# EasyEDA Pro project STM32F103C8T6_CAN.eprj (continued)
## Nets (continued)
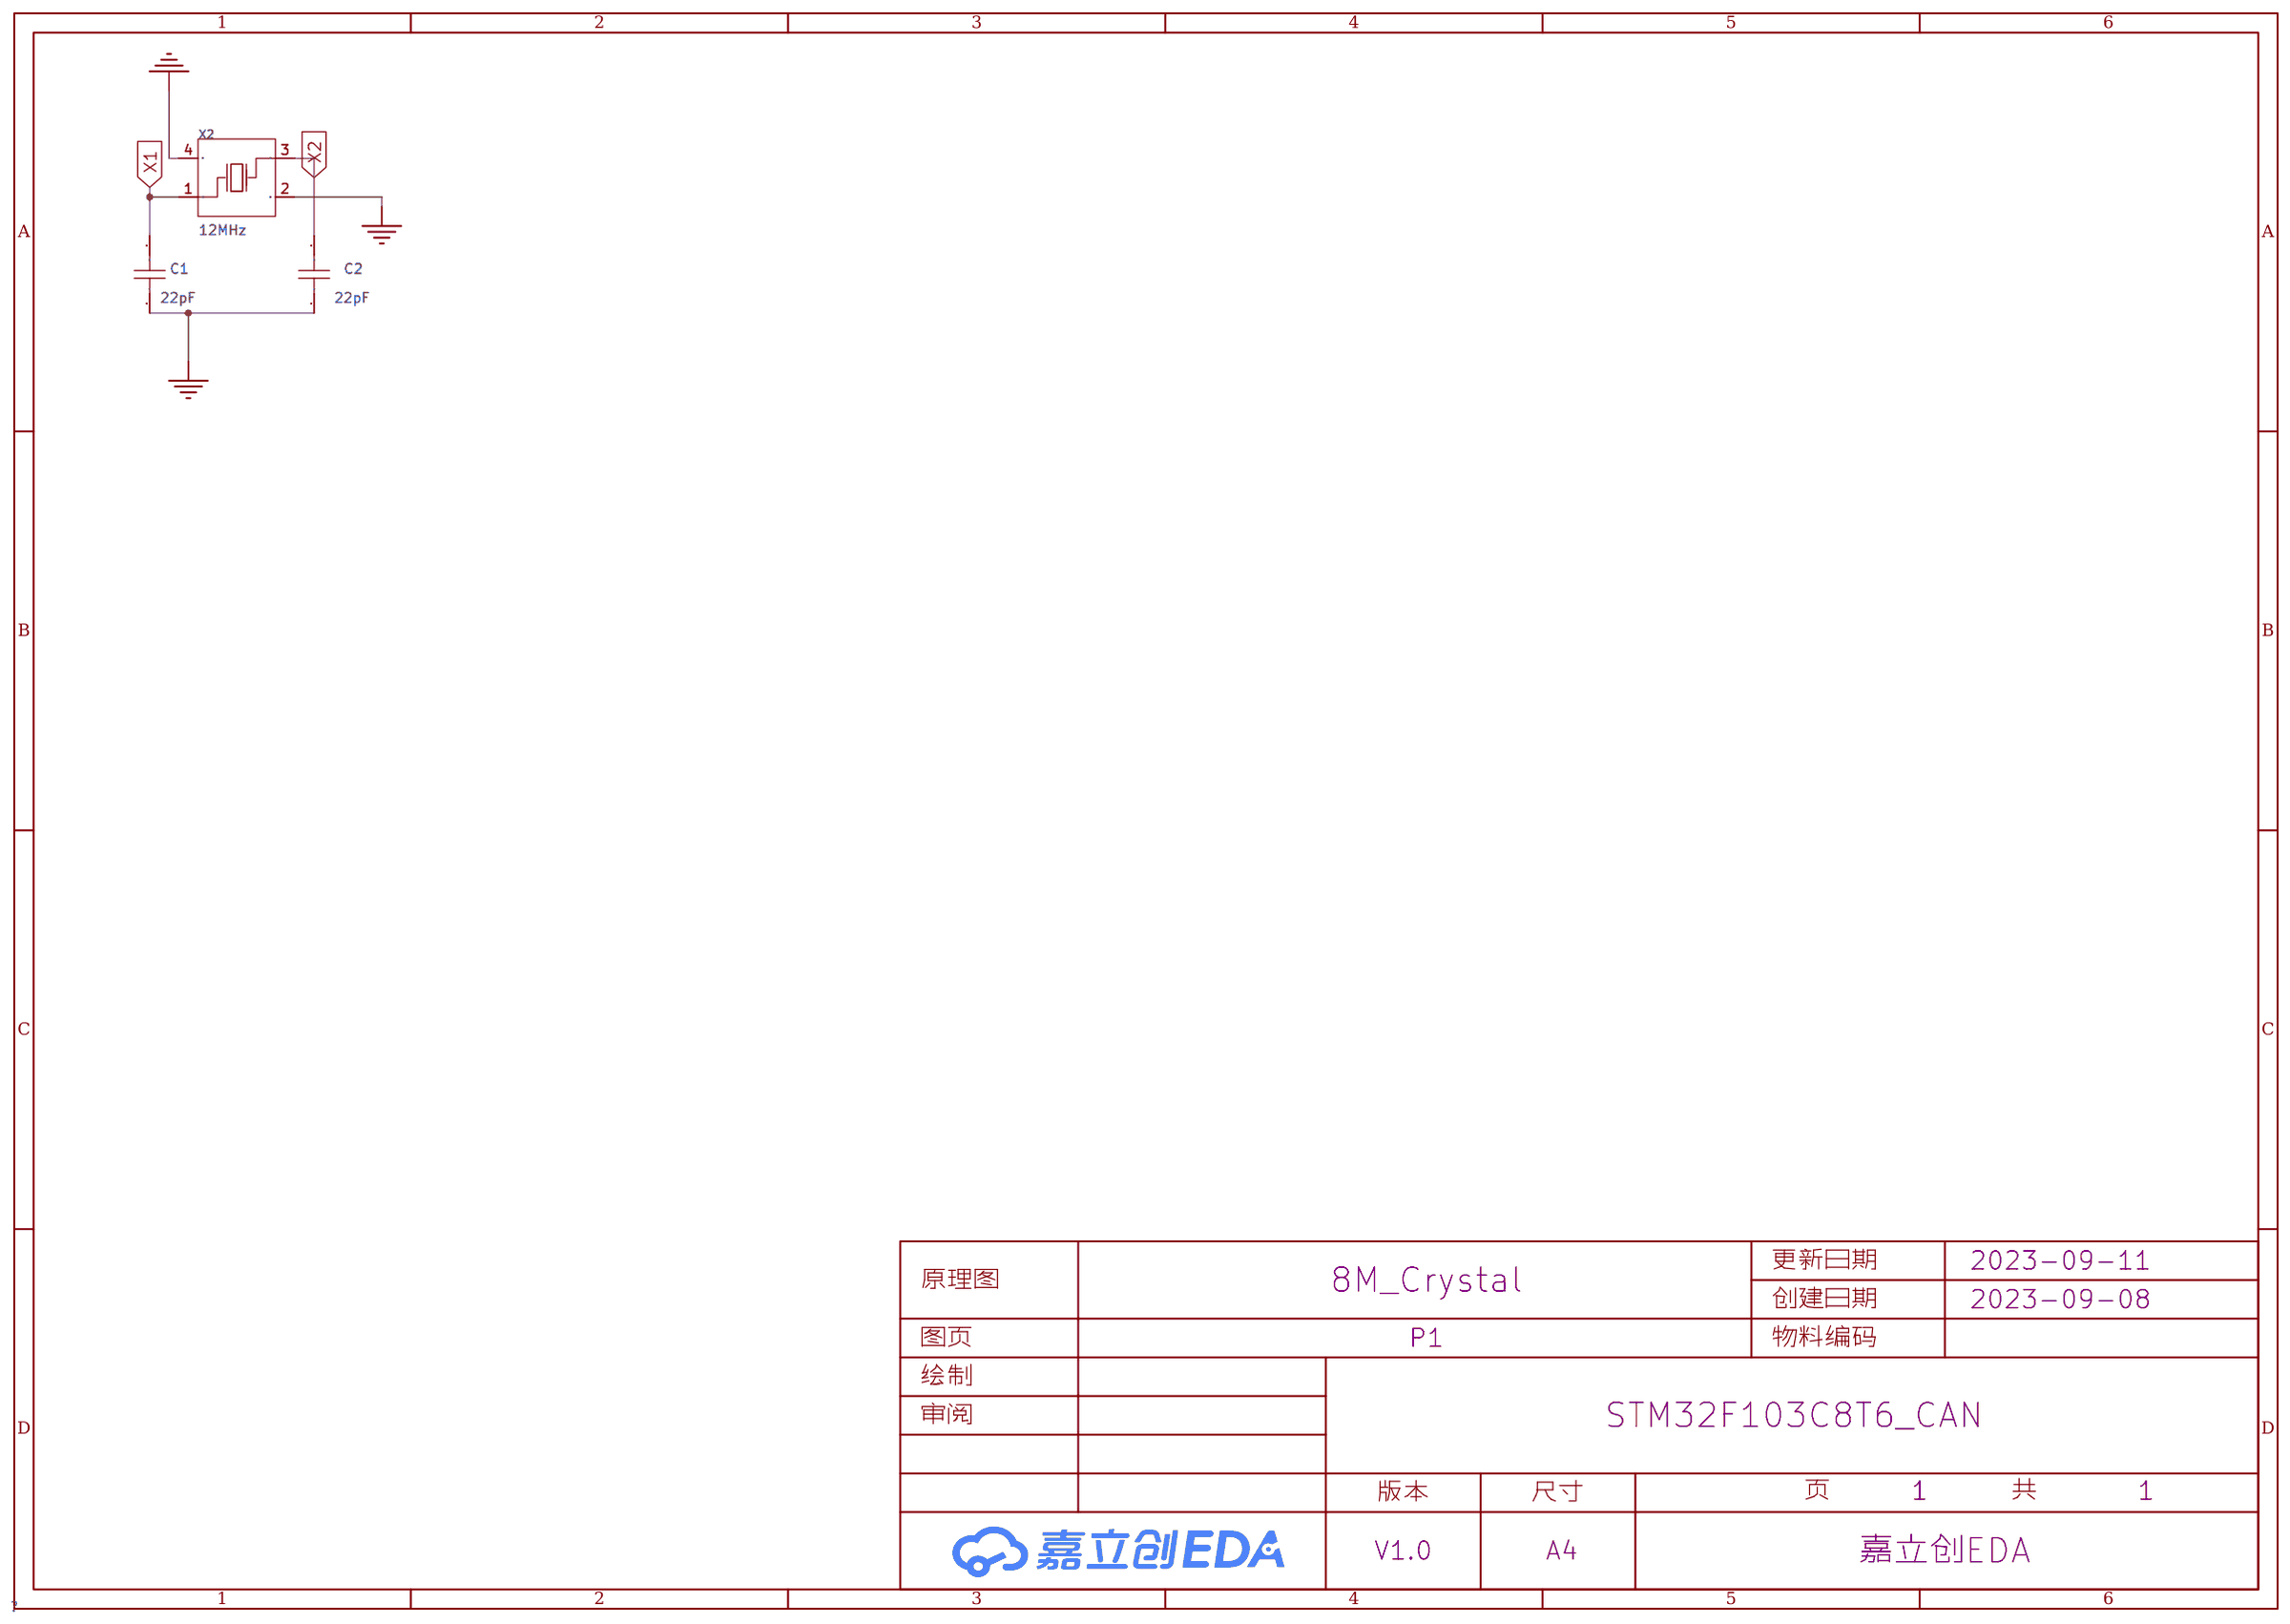
[diagram p1: schematic sheet]

## Parts
C1  22pF  [C0603]
C2  22pF  [C0603]
X2  12MHz  [OSC-SMD_4P-L3.2-W2.5-BL]

## Library data of the parts
C1 C2 = CAP_0603: Supplier Footprint: 0603
X2 = X322512MSB4SI: 频率:12MHz;频率公差:±10ppm;负载电容:20pF;; LCSC Part Name: 12MHz ±10ppm 20pF YSX321SL; Supplier Part: C9002; Manufacturer: YXC(扬兴晶振); Supplier Footprint: SMD3225-4P; JLCPCB Part Class: Basic Part; Datasheet: https://atta.szlcsc.com/upload/public/pdf/source/20210329/C112971_1F611BDC486E193C1706F6D8EB5AA189.pdf; Supplier: LCSC; Crystal Type: 贴片无源晶振; Frequency Tolerance: ±10ppm; Frequency Stability: ±30ppm; Load Capacitance: 20pF; Operating Temperature: -40℃~+85℃

## Nets
GND: C1.1 C2.1 X2.2(GND) X2.4(GND)
X1: C1.2 X2.1(OSC1)
X2: C2.2 X2.3(OSC2)

# Board PCB1
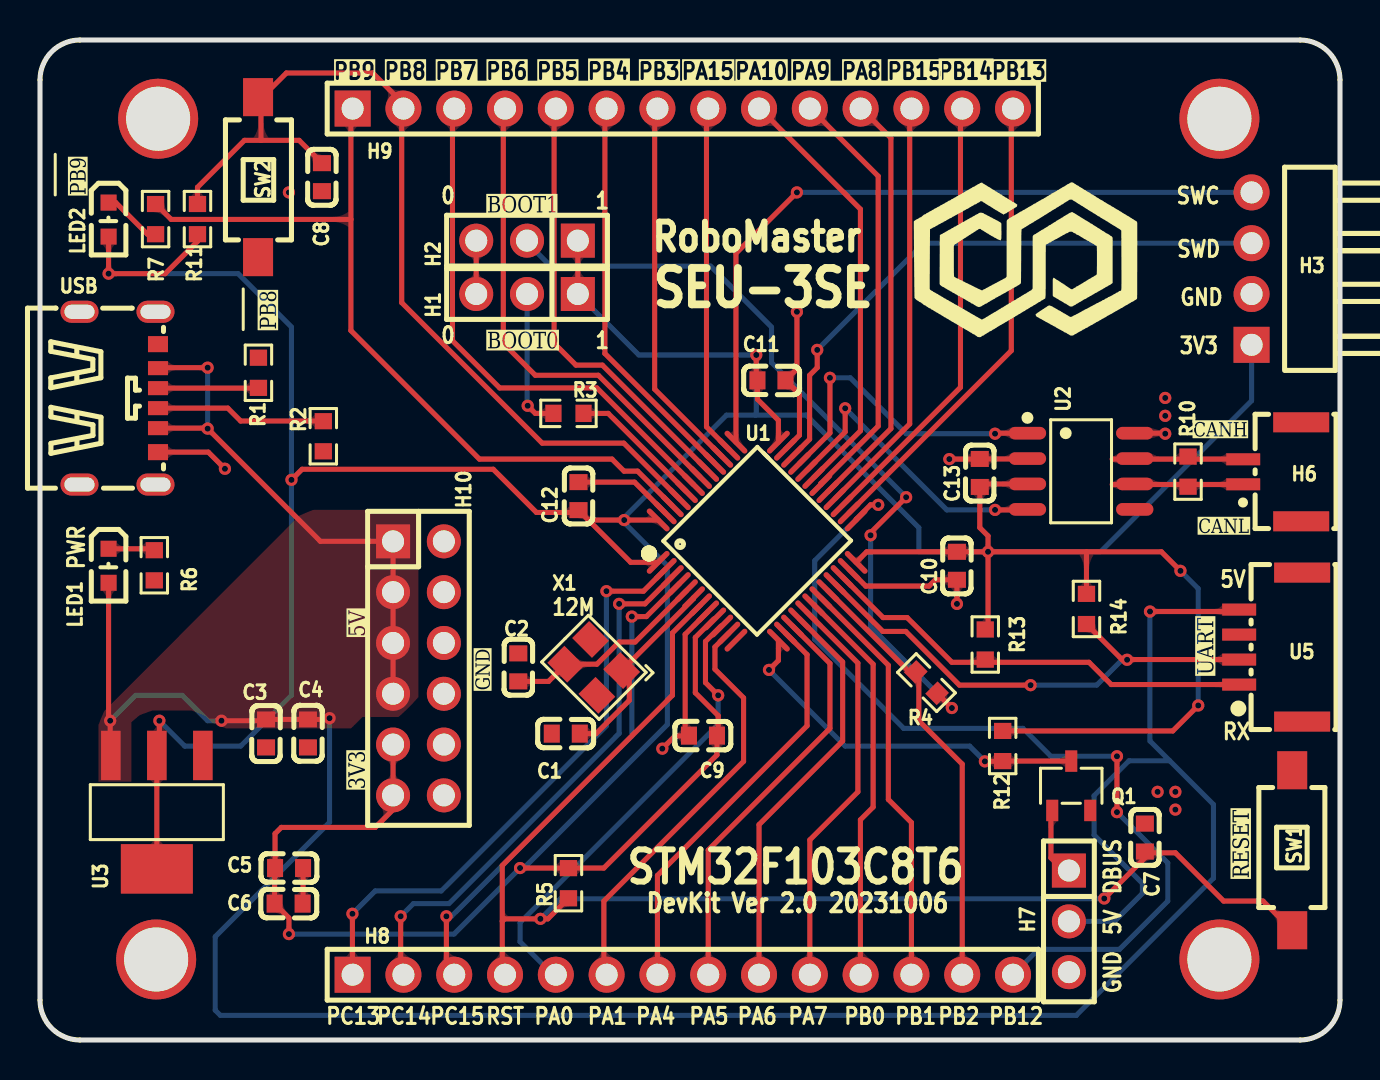
[diagram p2: board, top side]
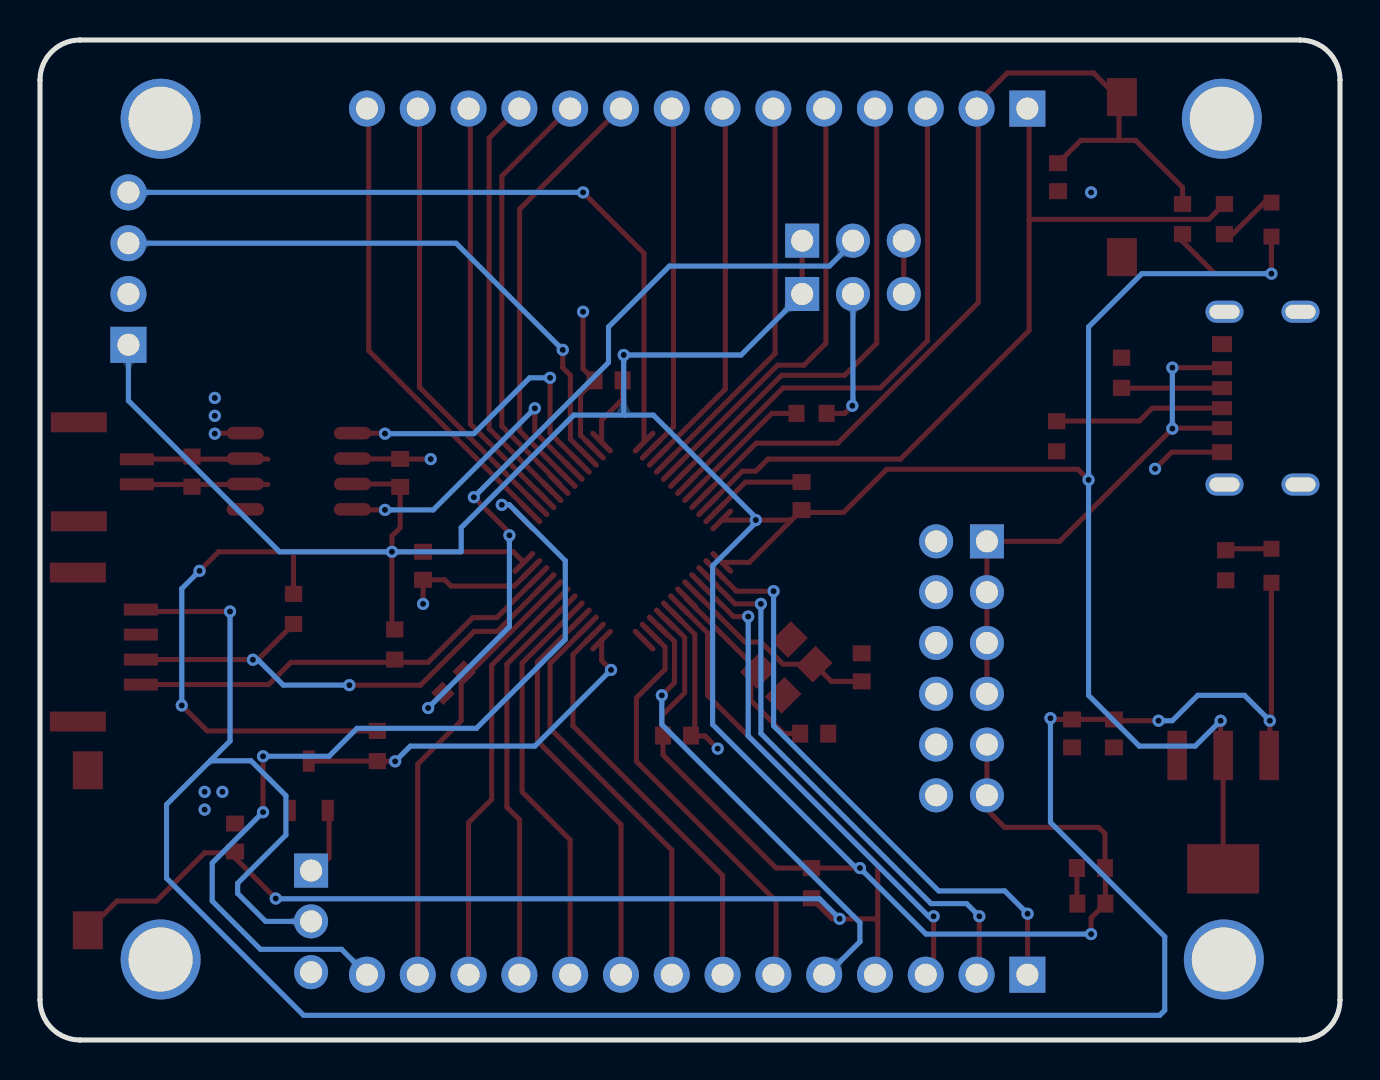
[diagram p3: board, bottom side, seen from below]

Outline 65 x 50 mm; copper layers: Top Layer, Bottom Layer. Coordinates in mm from the lower left corner of the outline.
Outline path: 0,48 0,2 arc(0.59,0.59) 2,0 63,0 arc(64.41,0.59) 65,2 65,48 arc(64.41,49.41) 63,50 2,50 arc(0.59,49.41) 0,48
Stack: Top Layer 0.035mm / Dielectric1 1.51mm FR4 er 4.5 / Bottom Layer 0.035mm

## Design rules (mm)
template: JLCPCB Capability(Two Layers Board)
spacing copperThickness1oz (default): track to track 0.102, other pairs 0.152 to 0.3
spacing copperThickness2oz: track to track 0.203, other pairs 0.152 to 0.3
track width copperThickness1oz (default): min 0.127, default 0.254, max 2.54
track width copperThickness2oz: min 0.203, default 0.254, max 2.54
differential pair differentialPair (default): width min 0.127, default 0.254, max 2.54; gap min 0.152, default 0.152
via viaSize (default): diameter min 0.5, default 0.61, max 10; hole min 0.3, default 0.305, max 6.3

## Placement (name value [footprint] x y rotation side)
C1  22pF  [C0603]  26.29 15.32 0 top
C2  22pF  [C0603]  23.91 18.63 270 top
C3  10uF  [C0603]  11.3 15.33 90 top
C4  0.1uF  [C0603]  13.4 15.33 270 top
C5  10uF  [C0603]  12.45 8.6 0 top
C6  0.1uF  [C0603]  12.43 6.82 180 top
C7  0.1uF  [C0603]  55.25 10.12 270 top
C8  0.1uF  [C0603]  14.1 43.14 90 top
C9  100nF  [C0603]  33.15 15.22 0 top
C10  100nF  [C0603]  45.85 23.71 90 top
C11  100nF  [C0603]  36.57 32.98 180 top
C12  100nF  [C0603]  26.92 27.19 270 top
C13  100nF  [C0603]  46.99 28.35 90 top
H1  PZ254V-11-03P  [HDR-TH_3P-P2.54-V-M]  24.35 37.3 180 top
H2  PZ254V-11-03P  [HDR-TH_3P-P2.54-V-M]  24.35 39.97 180 top
H3  PZ254R-11-04P  [HDR-TH_4P-P2.54-H-M-W10.4]  60.58 38.57 90 top
H6  PZ254-1-14-Z-8.5  [CONN-TH_2P-P1.25_XUNPU_WAFER-GH1.25-2PWB]  61.61 28.41 90 top
H7  PZ254-1-14-Z-8.5  [HDR-TH_3P-P2.54-V-M]  51.45 5.93 270 top
H8  PZ254-2-06-Z-8.5  [HDR-TH_14P-P2.54-V-M]  32.14 3.26 0 top
H9  WAFER-GH1.25-4PWB  [HDR-TH_14P-P2.54-V-M]  32.14 46.57 0 top
H10  PZ254-2-06-Z-8.5  [HDR-TH_12P-P2.54-V-M-R2-C6-S2.54]  18.92 18.58 270 top
LED1  NCD0603R3  [LED0603-R-RD_RED]  3.43 23.71 270 top
LED2  NCD0603R3  [LED0603-R-RD_RED]  3.43 41.02 270 top
NOREF  -  [Pad_e825]  5.91 46.06 0 top
NOREF#2  -  [Pad_e2538]  58.97 46.06 0 top
NOREF#3  -  [Pad_e2540]  58.97 4.03 0 top
NOREF#4  -  [Pad_e2198]  5.81 4.03 0 top
Q1  S8050  [SOT-23-3_L2.9-W1.6-P1.90-LS2.8-BR]  51.56 12.71 270 top
R1  5.1K  [R0603]  10.92 33.36 270 top
R2  5.1K  [R0603]  14.17 30.19 90 top
R3  10K  [R0603]  26.42 31.33 180 top
R4  10K  [R0603]  44.32 17.87 135 top
R5  10K  [R0603]  26.42 7.84 90 top
R6  1K  [R0603]  5.72 23.74 270 top
R7  1K  [R0603]  5.78 41.05 90 top
R10  10K  [R0603]  57.4 28.42 90 top
R11  10K  [R0603]  7.87 41.05 270 top
R12  10K  [R0603]  48.13 14.7 270 top
R13  10K  [R0603]  47.26 19.77 270 top
R14  10K  [R0603]  52.32 21.55 270 top
SW1  TS-1101-C-W  [SW-SMD_L6.0-W3.3-LS8.0]  62.61 9.49 270 top
SW2  TS-1101-C-W  [SW-SMD_L6.0-W3.3-LS8.0]  10.9 43.14 90 top
U1  STM32F103C8T6  [LQFP-48_L7.0-W7.0-P0.50-LS9.0-BL]  35.86 24.94 315 top
U2  SIT65HVD230DR  [SOP-8_L4.9-W3.9-P1.27-LS6.0-BL]  52.05 28.44 270 top
U3  AMS1117-3.3  [SOT-223-4_L6.5-W3.5-P2.30-LS7.0-BR]  5.84 11.39 90 top
U5  WAFER-GH1.25-4PWB  [CONN-SMD_4P-P1.25_XUNPU_WAFER-GH1.25-4PWB]  61.53 19.65 90 top
USB  TYPE-C 6P(073)  [TYPE-C-SMD_TYPE-C-6P]  3.94 32.09 270 top
X1  12MHz  [OSC-SMD_4P-L3.2-W2.5-BL]  27.69 18.63 135 top

## Footprints (pads in the part's own frame, mm; a bottom-side part is the same pattern mirrored in y, then rotated)
C0603
  rect 0.8x0.9 smd: 1(-0.7,0) 2(0.7,0)
CONN-SMD_4P-P1.25_XUNPU_WAFER-GH1.25-4PWB
  rect 0.6x1.7 smd: 1(-1.875,1.575) 2(-0.625,1.575) 3(0.625,1.575) 4(1.875,1.575)
  rect 1x2.8 smd: 5(3.725,-1.575) 6(-3.725,-1.575)
CONN-TH_2P-P1.25_XUNPU_WAFER-GH1.25-2PWB
  rect 0.6x1.7 smd: 1(-0.625,1.45) 2(0.625,1.45)
  rect 1x2.8 smd: 3(-2.475,-1.45) 4(2.475,-1.45)
HDR-TH_3P-P2.54-V-M
  rect 1.7x1.7 hole 1.1: 1(-2.54,0)
  round 1.7 hole 1.1: 2(0,0) 3(2.54,0)
HDR-TH_4P-P2.54-H-M-W10.4
  rect 1.8x1.8 hole 1.1: 1(-3.81,0)
  round 1.8 hole 1.1: 2(-1.27,0) 3(1.27,0) 4(3.81,0)
HDR-TH_12P-P2.54-V-M-R2-C6-S2.54
  rect 1.7x1.7 hole 1.1: 1(-6.35,-1.27)
  round 1.7 hole 1.1: 2(-6.35,1.27) 3(-3.81,-1.27) 4(-3.81,1.27) 5(-1.27,-1.27) 6(-1.27,1.27) 7(1.27,-1.27) 8(1.27,1.27) 9(3.81,-1.27) 10(3.81,1.27) 11(6.35,-1.27) 12(6.35,1.27)
HDR-TH_14P-P2.54-V-M
  rect 1.8x1.8 hole 1.1: 1(-16.51,0)
  round 1.8 hole 1.1: 2(-13.97,0) 3(-11.43,0) 4(-8.89,0) 5(-6.35,0) 6(-3.81,0) 7(-1.27,0) 8(1.27,0) 9(3.81,0) 10(6.35,0) 11(8.89,0) 12(11.43,0) 13(13.97,0) 14(16.51,0)
LED0603-R-RD_RED
  rect 0.8x0.8 smd: 1(0.851,0) 2(-0.851,0)
LQFP-48_L7.0-W7.0-P0.50-LS9.0-BL
  oval 0.27x1.5 smd: 1(-2.75,-4.25) 2(-2.25,-4.25) 3(-1.75,-4.25) 4(-1.25,-4.25) 5(-0.75,-4.25) 6(-0.25,-4.25) 7(0.25,-4.25) 8(0.75,-4.25) 9(1.25,-4.25) 10(1.75,-4.25) 11(2.25,-4.25) 12(2.75,-4.25) 25(2.75,4.25) 26(2.25,4.25) 27(1.75,4.25) 28(1.25,4.25) 29(0.75,4.25) 30(0.25,4.25) 31(-0.25,4.25) 32(-0.75,4.25) 33(-1.25,4.25) 34(-1.75,4.25) 35(-2.25,4.25) 36(-2.75,4.25)
  oval 1.5x0.27 smd: 13(4.25,-2.75) 14(4.25,-2.25) 15(4.25,-1.75) 16(4.25,-1.25) 17(4.25,-0.75) 18(4.25,-0.25) 19(4.25,0.25) 20(4.25,0.75) 21(4.25,1.25) 22(4.25,1.75) 23(4.25,2.25) 24(4.25,2.75) 37(-4.25,2.75) 38(-4.25,2.25) 39(-4.25,1.75) 40(-4.25,1.25) 41(-4.25,0.75) 42(-4.25,0.25) 43(-4.25,-0.25) 44(-4.25,-0.75) 45(-4.25,-1.25) 46(-4.25,-1.75) 47(-4.25,-2.25) 48(-4.25,-2.75)
OSC-SMD_4P-L3.2-W2.5-BL
  rect 1.4x1.2 smd: 1(-1.1,-0.875) 2(1.1,-0.875) 3(1.1,0.875) 4(-1.1,0.875)
Pad_e825
  round 4 hole 3.2: 15(0,0)
Pad_e2198
  round 4 hole 3.2: 15(0,0)
Pad_e2538
  round 4 hole 3.2: 15(0,0)
Pad_e2540
  round 4 hole 3.2: 15(0,0)
R0603
  rect 0.806x0.864 smd: 1(-0.753,0) 2(0.753,0)
SOP-8_L4.9-W3.9-P1.27-LS6.0-BL
  oval 0.63x1.865 smd: 1(-1.905,-2.683) 2(-0.635,-2.683) 3(0.635,-2.683) 4(1.905,-2.683) 5(1.905,2.683) 6(0.635,2.683) 7(-0.635,2.683) 8(-1.905,2.683)
SOT-23-3_L2.9-W1.6-P1.90-LS2.8-BR
  rect 1.07x0.6 smd: 1(1.235,-0.95) 2(1.235,0.95) 3(-1.235,0)
SOT-223-4_L6.5-W3.5-P2.30-LS7.0-BR
  rect 2.47x0.98 smd: 1(2.835,-2.3) 2(2.835,0) 3(2.835,2.3)
  rect 2.47x3.6 smd: 4(-2.835,0)
SW-SMD_L6.0-W3.3-LS8.0
  rect 1.9x1.5 smd: 1(-4,0) 2(4,0)
TYPE-C-SMD_TYPE-C-6P
  oval 1.1x1.9 hole 0.7x1.5: 7(-4.32,1.837) 7(-4.32,-1.962) 7(4.32,1.837) 7(4.32,-1.962)
  rect 0.7x1 smd: A5(-0.5,1.962) A9(1.5,1.962) B5(0.5,1.962) B9(-1.5,1.962)
  rect 0.8x1 smd: A12(2.7,1.962) B12(-2.7,1.962)

## Nets
+5V: C3.2 C4.1 H7.2 H10.1 H10.3 H10.5 H10.7 LED1.1 U3.3 U5.4 USB.A9 USB.B9
GND: C1.1 C2.1 C3.1 C4.2 C5.2 C6.1 C7.1 C8.1 C9.1 C10.1 C11.1 C12.1 C13.2 H1.3 H2.3 H3.2 H6.3 H6.4 H7.3 H10.2 H10.4 H10.6 H10.8 H10.10 H10.12 NOREF.15 NOREF#2.15 NOREF#3.15 NOREF#4.15 Q1.2 R1.1 R2.1 R6.2 SW1.1 SW2.1 U1.8 U1.23 U1.35 U1.47 U2.2 U2.8 U3.1 U5.3 U5.5 U5.6 USB.7 USB.A12 USB.B12 X1.2 X1.4
VCC: C5.1 C6.2 C9.2 C10.2 C11.2 C12.2 C13.1 H1.1 H2.1 H3.1 H10.9 H10.11 LED2.1 R5.2 R11.2 R12.1 R13.1 R14.1 U1.1 U1.9 U1.24 U1.36 U1.48 U2.3 U3.2 U3.4
BOOT0: H1.2 R3.2
BOOT1: H2.2 R4.1
CANH: H6.2 R10.2 U2.7
CANL: H6.1 R10.1 U2.6
PA0: H8.5 U1.10
PA1: H8.6 U1.11
PA2: U1.12
PA3_DBUS: Q1.3 R12.2 U1.13
PA4: H8.7 U1.14
PA5: H8.8 U1.15
PA6: H8.9 U1.16
PA7: H8.10 U1.17
PA8: H9.11 U1.29
PA9: H9.10 U1.30
PA10: H9.9 U1.31
PA11_CAN_RX: U1.32 U2.4
PA12_CAN_TX: U1.33 U2.1
PA13_SWD: H3.3 U1.34
PA14_SWC: H3.4 U1.37
PA15: H9.8 U1.38
PB0: H8.11 U1.18
PB1: H8.12 U1.19
PB2: H8.13 R4.2 U1.20
PB3: H9.7 U1.39
PB4: H9.6 U1.40
PB5: H9.5 U1.41
PB6: H9.4 U1.42
PB7: H9.3 U1.43
PB8: C8.2 H9.2 R11.1 SW2.2 U1.45
PB9: H9.1 R7.2 U1.46
PB10_UART3_TX: R14.2 U1.21 U5.2
PB11_UART3_RX: R13.2 U1.22 U5.1
PB12: H8.14 U1.25
PB13: H9.14 U1.26
PB14: H9.13 U1.27
PB15: H9.12 U1.28
PC13: H8.1 U1.2
PC14: H8.2 U1.3
PC15: H8.3 U1.4
PD0: C2.2 U1.5 X1.3
PD1: C1.2 U1.6 X1.1
RST: C7.2 H8.4 R5.1 SW1.2 U1.7
$1N3196: R3.1 U1.44
$1N3644: LED1.2 R6.1
$1N3970: LED2.2 R7.1
$1N9993: R2.2 USB.B5
$1N9997: R1.2 USB.A5
$1N21284: H7.1 Q1.1

Pads without a net: U2 5

## Via types
v1: diameter 0.61, hole 0.305, Top Layer to Bottom Layer, 54 vias

## Routing (per net, layer and track width the routed paths; a pad name or vN(x,y) marks a point on that pad's centre or on a via; arc(x,y) is an arc through that point)
+5V: length 151.9
  Top Layer w0.254: LED1.1 3.43,16.04 v1(3.51,15.96) 3.51,13.97 ; v1(9.07,15.96) 11.24,15.96 C3.2 C4.1 14.42,16.03 v1(14.48,16.09) ; H10.7 H10.5 H10.3 H10.1 14.02,24.93 v1(8.38,30.57) 8.36,30.59 USB.A9 ; v1(55.5,21.42) 59.86,21.42 59.96,21.52 ; USB.B9 5.92,33.62 v1(8.38,33.62)
  Bottom Layer w0.254: 56.49,13.96 54.45,13.96 52.71,12.22 52.71,10.25 55.12,7.84 55.12,7.33 53.72,5.93 H7.2 ; 56.49,13.96 58.67,11.77 58.67,8.09 51.82,1.23 9.02,1.23 8.76,1.49 8.76,5.17 14.48,10.88 v1(14.48,16.09) ; 56.49,13.96 55.5,14.95 v1(55.5,21.42) ; v1(3.51,15.96) 4.78,17.23 7.11,17.23 8.38,15.96 v1(9.07,15.96) ; v1(8.38,30.57) v1(8.38,33.62)
GND: length 41.7
  Top Layer w0.254: C6.1 13.15,6.84 C5.2 ; U2.2 49.35,29.05 C13.2 46.98,29.05 v1(45.47,29.05) ; v1(31.12,14.57) 31.75,15.2 32.43,15.2 C9.1 ; 37.27,29.54 37.97,30.24 37.97,32.28 C11.1 37.85,33.56 v1(37.85,36.41) ; 32.45,15.22 32.26,15.41 32.26,20.28 33.38,21.41 ; 54.74,30.34 56.24,30.34 v1(56.26,30.31) ; USB.A12 8.41,29.39 v1(9.25,28.56) ; v1(45.85,21.81) C10.1 44.77,23.01 44.45,22.69 41.29,22.69 U1.23 ; U1.47 29.72,27.89 C12.1 ; H2.3 H1.3
  vias: v1(12.45,42.38) v1(55.88,12.41) v1(56.26,32.1) v1(56.26,31.21) v1(56.77,12.41) v1(56.77,11.52)
VCC: length 255.2
  Top Layer w0.254: v1(47.4,24.41) C10.2 41.34,24.41 U1.24 ; v1(47.4,24.41) 47.4,25.2 46.99,25.62 C13.1 47.14,27.8 U2.3 ; v1(47.4,24.41) 52.32,24.41 ; v1(47.4,24.41) 47.4,20.67 47.42,20.65 ; 33.69,21.05 32.77,20.13 32.77,17.36 33.91,16.22 33.91,15.55 33.85,15.48 C9.2 33.85,14.25 28.19,8.6 v1(24,8.6) ; 52.32,24.41 R14.1 ; 52.32,24.41 56.07,24.41 v1(57.02,23.46) ; LED2.1 v1(3.43,38.32) 6.26,38.32 7.87,39.93 R11.2 ; v1(12.57,28.01) 13.1,28.54 22.66,28.54 24.82,26.38 26.81,26.38 C12.2 27.42,26 ; 27.42,26 29.54,23.88 U1.1 ; 27.42,26 v1(29.21,26) 30.9,26 U1.48 ; U1.36 36.92,30.99 35.87,32.03 C11.2 35.81,33.04 v1(35.81,34.25) ; 5.84,14.23 5.84,14.01 ; 5.84,14.01 U3.4 ; 5.84,14.01 5.97,14.13 v1(5.97,15.96) ; 5.84,14.01 5.81,13.97 ; v1(12.45,5.3) 12.45,6.1 C6.2 11.73,8.57 C5.1 11.75,10.32 12.06,10.63 16.76,10.63 17.65,11.52 H10.11 H10.9 ; R12.1 56.64,15.45 58.04,16.85 ; H2.1 H1.1
  Bottom Layer w0.254: v1(3.43,38.32) 9.91,38.32 12.57,35.65 v1(12.57,28.01) 12.57,17.23 10.03,14.69 7.24,14.69 v1(5.97,15.96) ; H1.1 29.94,34.25 v1(35.81,34.25) 35.81,31.3 35.76,31.24 ; H3.1 60.58,31.97 53.02,24.41 v1(47.4,24.41) 43.94,24.41 43.94,25.62 38.31,31.24 35.76,31.24 ; v1(57.02,23.46) 57.91,22.57 v1(57.91,16.73) ; 35.76,31.24 34.33,31.24 29.08,26 31.37,23.71 31.37,15.77 24.19,8.6 v1(24,8.6) 20.7,5.3 v1(12.45,5.3)
BOOT0: length 7
  Top Layer w0.254: v1(24.38,31.71) 24.76,31.33 R3.2
  Bottom Layer w0.254: H1.2 24.35,31.74 v1(24.38,31.71)
BOOT1: length 39.4
  Top Layer w0.254: v1(45.59,16.6) R4.1 ; v1(41.53,25.23) 41.53,25.36 v1(43.31,27.14)
  Bottom Layer w0.254: v1(41.53,25.23) 41.53,20.66 v1(45.59,16.6) ; H2.2 24.35,39.87 25.53,38.7 33.53,38.7 36.58,35.65 36.58,33.87 v1(43.31,27.14)
CANH: length 6.1
  Top Layer w0.254: 53.61,29.05 59.73,29.05 59.72,29.05
CANL: length 6.1
  Top Layer w0.254: 59.72,27.8 59.69,27.78 53.61,27.78
PA0: length 22.8
  Top Layer w0.254: v1(33.91,17.23) 33.27,17.87 33.27,19.93 34.05,20.7
  Bottom Layer w0.254: 25.65,3.26 24,4.92 24,5.87 33.91,15.77 v1(33.91,17.23)
PA1: length 20.9
  Top Layer w0.254: 28.19,3.26 28.19,6.95 35.18,13.93 35.18,17.11 33.75,18.54 33.75,19.65 U1.11
PA3_DBUS: length 18.7
  Top Layer w0.254: U1.13 36.92,18.97 v1(36.45,18.5) ; v1(47.24,13.93) 48.12,13.93 R12.2 Q1.3
  Bottom Layer w0.254: v1(47.24,13.93) 46.48,14.69 40.26,14.69 v1(36.45,18.5)
PA4: length 20.6
  Top Layer w0.254: U1.14 38.35,19.27 38.35,15.71 30.87,8.23 H8.7
PA5: length 20.7
  Top Layer w0.254: U1.15 39.5,18.83 39.5,15.58 33.41,9.5 H8.8
PA6: length 20.4
  Top Layer w0.254: H8.9 35.95,10.77 40.13,14.95 40.13,18.9 U1.16
PA7: length 20.2
  Top Layer w0.254: H8.10 38.49,10.01 40.89,12.41 40.89,18.85 38.33,21.41
PA8: length 21.2
  Top Layer w0.254: U1.29 42.54,30.57 42.54,45.1 40.94,46.7
PA9: length 21.6
  Top Layer w0.254: 38.4,46.7 41.91,43.19 41.91,30.7 39.04,27.83 39.04,27.77
PA10: length 21.7
  Top Layer w0.254: 38.69,28.12 41.02,30.46 41.02,41.54 35.86,46.7
PA11_CAN_RX: length 15.1
  Top Layer w0.254: v1(40.26,31.58) 40.26,30.4 38.33,28.48 ; U2.4 49.35,26.5 v1(47.75,26.5)
  Bottom Layer w0.254: v1(47.75,26.5) 45.34,26.5 v1(40.26,31.58)
PA12_CAN_TX: length 15.9
  Top Layer w0.254: 49.37,30.34 47.78,30.34 v1(47.75,30.31) ; U1.33 39.5,30.35 v1(39.5,33.11)
  Bottom Layer w0.254: v1(47.75,30.31) 43.31,30.31 40.51,33.11 v1(39.5,33.11)
PA13_SWD: length 29.8
  Top Layer w0.254: v1(38.86,34.51) 38.86,33.62 38.48,33.24 38.48,30.04 U1.34
  Bottom Layer w0.254: v1(38.86,34.51) 44.2,39.84 H3.3
PA14_SWC: length 36.4
  Top Layer w0.254: v1(37.85,42.38) 34.8,39.33 U1.37
  Bottom Layer w0.254: 60.45,42.38 v1(37.85,42.38)
PA15: length 17.6
  Top Layer w0.254: 34.44,29.54 33.32,30.66 33.32,46.7
PB0: length 20
  Top Layer w0.254: H8.11 41.02,3.27 41.02,11.01 41.66,11.65 41.66,18.79 38.69,21.76
PB1: length 20.7
  Top Layer w0.254: H8.12 43.57,10.87 42.42,12.03 42.42,18.74 U1.19
PB2: length 22.2
  Top Layer w0.254: U1.20 43.46,18.4 R4.2 43.94,18.25 43.94,15.96 46.11,13.79 H8.13
PB3: length 18.9
  Top Layer w0.254: 30.78,46.7 30.73,46.65 30.73,32.54 U1.39
PB4: length 20.1
  Top Layer w0.254: 28.24,46.7 28.24,34.32 33.74,28.83
PB5: length 22.2
  Top Layer w0.254: U1.41 28.12,33.74 26.8,33.74 25.7,34.84 25.7,46.7
PB6: length 24.5
  Top Layer w0.254: 23.16,46.7 23.16,34.84 24.76,33.24 27.92,33.24 U1.42
PB7: length 26.8
  Top Layer w0.254: 32.68,27.77 27.84,32.6 22.99,32.6 20.62,34.96 20.62,46.7
PB8: length 46.9
  Top Layer w0.254: H9.2 18.17,46.81 16.64,48.35 12.32,48.35 11.05,47.08 11.05,44.98 ; 11.05,44.98 10.22,44.98 7.87,42.63 R11.1 ; 11.05,44.98 12.96,44.98 C8.2 ; 18.08,46.7 18.08,36.87 25.11,29.84 29.19,29.84 U1.45
PB9: length 41
  Top Layer w0.254: 5.84,41.8 5.84,41.75 6.56,41.03 15.54,41.03 ; U1.46 29.88,28.44 29.2,28.44 28.6,29.05 21.97,29.05 15.54,35.47 15.54,41.03 ; 15.54,41.03 15.54,46.7
PB10_UART3_TX: length 25.6
  Top Layer w0.254: R14.2 54.11,19.01 v1(54.36,19.01) 54.37,19.02 59.96,19.02 ; v1(49.53,17.74) 45.97,17.74 43.29,20.43 42.14,20.43 U1.21
  Bottom Layer w0.254: v1(49.53,17.74) 52.83,17.74 54.1,19.01 v1(54.36,19.01)
PB11_UART3_RX: length 22.1
  Top Layer w0.254: 59.96,17.77 53.56,17.77 52.45,18.89 45.59,18.89 43.36,21.12 42.16,21.12 40.1,23.17
PB12: length 44.8
  Top Layer w0.254: U1.25 40.81,26.04 41.53,26.76 v1(41.91,26.76) ; v1(53.85,14.19) v1(53.85,11.39)
  Bottom Layer w0.254: H8.14 49.92,4.53 53.97,4.53 56.39,6.95 56.39,8.85 v1(53.85,11.39) ; v1(41.91,26.76) 41.53,26.76 38.74,23.97 38.74,20.03 43.18,15.58 49.15,15.58 50.55,14.19 v1(53.85,14.19)
PB13: length 23.7
  Top Layer w0.254: 48.56,46.7 48.56,34.47 U1.26
PB14: length 22.4
  Top Layer w0.254: 40.1,26.71 46.02,32.63 46.02,46.7
PB15: length 21.2
  Top Layer w0.254: U1.28 43.48,30.8 43.48,46.7
PC13: length 29.8
  Top Layer w0.254: v1(28.32,22.44) 30.18,22.44 U1.2 ; 15.49,3.26 15.62,3.39 v1(15.62,6.31)
  Bottom Layer w0.254: v1(15.62,6.31) 16.76,7.45 20.07,7.45 28.32,15.71 v1(28.32,22.44)
PC14: length 27.3
  Top Layer w0.254: v1(28.96,21.81) 30.25,21.81 31.62,23.17 ; v1(18.03,6.19) 18.03,3.26
  Bottom Layer w0.254: v1(28.96,21.81) 28.96,15.33 20.45,6.82 18.67,6.82 v1(18.03,6.19)
PC15: length 25.1
  Top Layer w0.254: U1.4 30.32,21.17 v1(29.59,21.17) ; 20.57,3.26 20.32,3.52 v1(20.32,6.19)
  Bottom Layer w0.254: v1(29.59,21.17) 29.59,15.2 20.57,6.19 v1(20.32,6.19)
PD0: length 10.3
  Top Layer w0.254: 32.32,22.47 29.76,19.9 28.96,19.9 27.84,18.79 X1.3 25.43,17.93 C2.2
PD1: length 9.9
  Top Layer w0.254: U1.6 32.68,22.07 X1.1 29.46,18.09 29.46,16.98 27.8,15.32 C1.2
RST: length 67
  Top Layer w0.254: v1(53.21,7.07) 55.5,9.36 56.77,9.36 59.18,6.95 61.15,6.95 SW1.2 ; U1.7 31.62,20.35 31.62,17.23 23.11,8.72 23.11,5.94 ; 23.11,5.94 23.23,6.06 v1(25.02,6.06) 25.39,6.06 26.42,7.09 ; 23.11,5.94 23.11,3.26
  Bottom Layer w0.254: v1(25.02,6.06) 26.02,7.06 53.2,7.06 v1(53.21,7.07)
$1N3196: length 6.8
  Top Layer w0.254: R3.1 28.41,31.33 32.32,27.42
$1N3644: length 2.3
  Top Layer w0.254: LED1.2 5.64,24.56 R6.1
$1N3970: length 3
  Top Layer w0.254: R7.1 5.37,40.29 3.79,41.87 LED2.2
$1N9993: length 8.6
  Top Layer w0.254: 14.17,30.81 14.03,30.95 10.03,30.95 9.39,31.59 USB.B5
$1N9997: length 5
  Top Layer w0.254: USB.A5 10.91,32.59 R1.2
$1N21284: length 4.1
  Top Layer w0.254: 52.01,8.47 51.18,8.47 50.55,9.11 50.55,11.41 Q1.1

## Copper pours and planes (outline as drawn; the poured copper is in the pictures)
+5V on Top Layer: 2.92,26.5 18.92,26.5 18.92,12.92 2.92,12.92
GND on Top Layer: 0,48 0.02,48.28 0.08,48.56 0.18,48.83 0.32,49.08 0.49,49.31 0.69,49.51 0.92,49.68 1.17,49.82 1.44,49.92 1.72,49.98 2,50 63,50 63.28,49.98 63.56,49.92 63.83,49.82 64.08,49.68 64.31,49.51 64.51,49.31 64.68,49.08 64.82,48.83 64.92,48.56 64.98,48.28 65,48 65,2 64.98,1.72 64.92,1.44 64.82,1.17 64.68,0.92 64.51,0.69 64.31,0.49 64.08,0.32 63.83,0.18 63.56,0.08 63.28,0.02 63,0 2,0 1.72,0.02 1.44,0.08 1.17,0.18 0.92,0.32 0.69,0.49 0.49,0.69 0.32,0.92 0.18,1.17 0.08,1.44 0.02,1.72 0,2
GND on Bottom Layer: 0,48 0.02,48.28 0.08,48.56 0.18,48.83 0.32,49.08 0.49,49.31 0.69,49.51 0.92,49.68 1.17,49.82 1.44,49.92 1.72,49.98 2,50 63,50 63.28,49.98 63.56,49.92 63.83,49.82 64.08,49.68 64.31,49.51 64.51,49.31 64.68,49.08 64.82,48.83 64.92,48.56 64.98,48.28 65,48 65,2 64.98,1.72 64.92,1.44 64.82,1.17 64.68,0.92 64.51,0.69 64.31,0.49 64.08,0.32 63.83,0.18 63.56,0.08 63.28,0.02 63,0 2,0 1.72,0.02 1.44,0.08 1.17,0.18 0.92,0.32 0.69,0.49 0.49,0.69 0.32,0.92 0.18,1.17 0.08,1.44 0.02,1.72 0,2

Small or netless copper shapes (teardrops, artwork), in the pictures only: 248 on Top Layer, 58 on Bottom Layer

## Text on the board
Top Silkscreen Layer: PC13 | PC14 | PC15 | RST | PA0 | PA1 | PA4 | PA5 | PA6 | PA7 | PB0 | PB1 | PB2 | PB12 | SWC | SWD | 3V3 | GND | DBUS | 5V | PB9 | PB8 | PB7 | PB6 | PB5 | 12M | PB4 | PB3 | PA15 | PA10 | PA9 | PA8 | PB15 | PB14 | PB13 | RX | PWR | 0 | 1 | DevKit Ver 2.0 20231006 | RoboMaster | STM32F103C8T6 | SEU-3SE | CANH | CANL | UART | RESET | BOOT1 | BOOT0
